# Altium schematic sheet Minion.SchDoc (part 3 of 4)
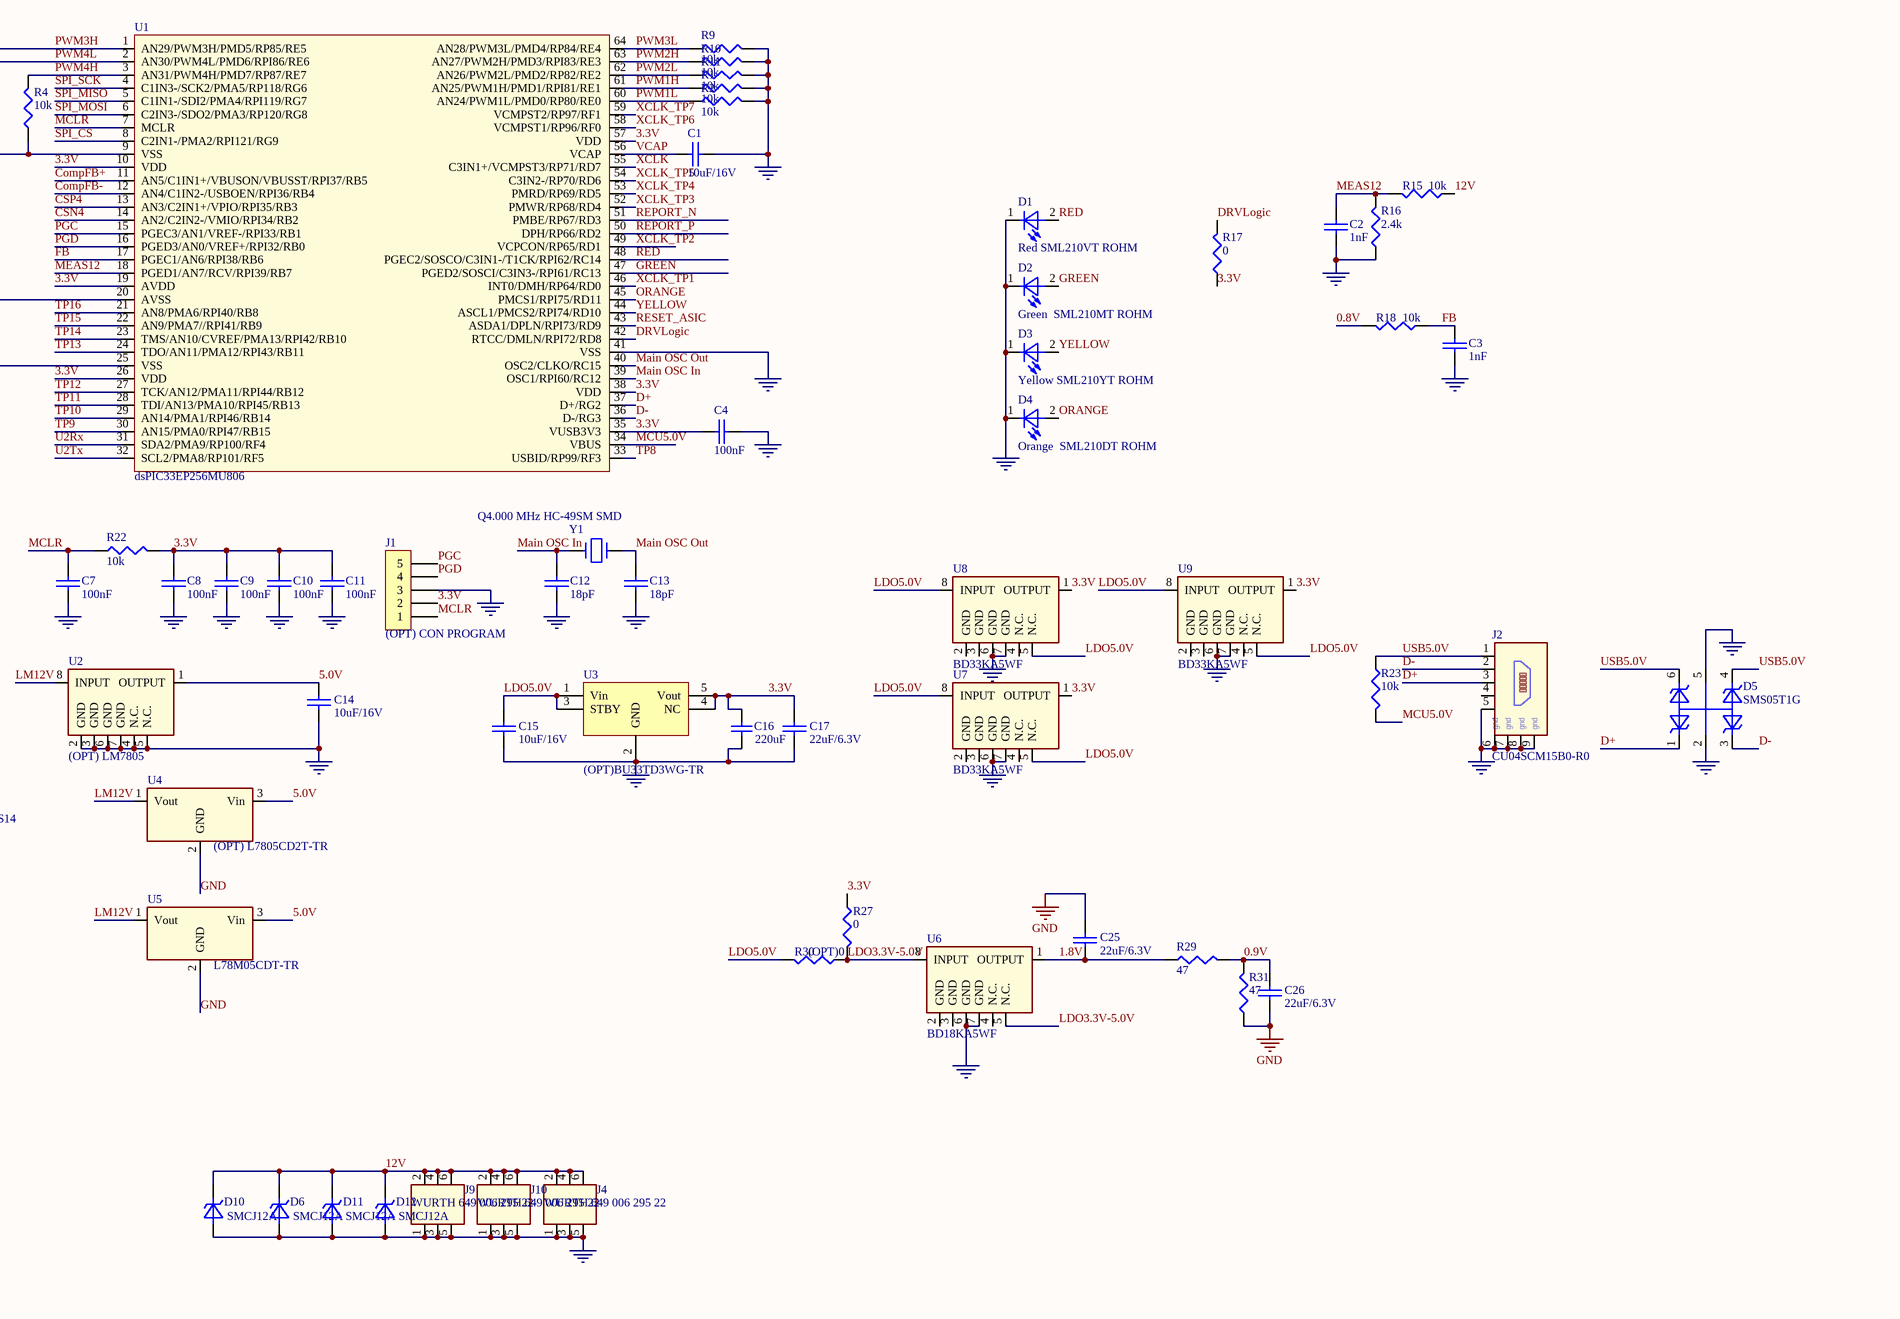
[diagram p7: Minion.SchDoc, bottom right]

## Nets (continued)
GND: C1.2 C1P_1.1 C1P_2.1 C1P_3.1 C1P_4.1 C1P_5.1 C1P_6.1 C1P_7.1 C1P_8.1 C2.2 C2P_1.2 C2P_2.2 C2P_3.2 C2P_4.2 C2P_5.2 C2P_6.2 C2P_7.2 C2P_8.2 C3.2 C4.2 C4P_1.2 C4P_2.2 C4P_3.2 C4P_4.2 C4P_5.2 C4P_6.2 C4P_7.2 C4P_8.2 C5P_1.2 C5P_2.2 C5P_3.2 C5P_4.2 C5P_5.2 C5P_6.2 C5P_7.2 C5P_8.2 C6P_1.2 C6P_2.2 C6P_3.2 C6P_4.2 C6P_5.2 C6P_6.2 C6P_7.2 C6P_8.2 C7.2 C7P_1.2 C7P_2.2 C7P_3.2 C7P_4.2 C7P_5.2 C7P_6.2 C7P_7.2 C7P_8.2 C8.2 C8P_1.2 C8P_2.2 C8P_3.2 C8P_4.2 C8P_5.2 C8P_6.2 C8P_7.2 C8P_8.2 C9.2 C9P_1.2 C9P_2.2 C9P_3.2 C9P_4.2 C9P_5.2 C9P_6.2 C9P_7.2 C9P_8.2 C10.2 C10P_1.2 C10P_2.2 C10P_3.2 C10P_4.2 C10P_5.2 C10P_6.2 C10P_7.2 C10P_8.2 C11.2 C11P_1.2 C11P_2.2 C11P_3.2 C11P_4.2 C11P_5.2 C11P_6.2 C11P_7.2 C11P_8.2 C12.2 C12P_1.2 C12P_2.2 C12P_3.2 C12P_4.2 C12P_5.2 C12P_6.2 C12P_7.2 C12P_8.2 C13.2 C14.2 C15.2 C16.2 C17.2 C25.1 C26.2 CF_1.2 CF_2.2 CF_3.2 CF_4.2 CF_5.2 CF_6.2 CF_7.2 CF_8.2 CF_9.2 CF_10.2 CF_11.2 CF_12.2 CF_13.2 CF_14.2 CF_15.2 CF_16.2 CF_17.2 CF_18.2 CF_19.2 CF_20.2 CF_21.2 CF_22.2 CF_23.2 CF_24.2 CF_25.2 CF_26.2 CF_27.2 CF_28.2 CF_29.2 CF_30.2 CF_31.2 CF_32.2 CF_33.2 CF_34.2 CF_35.2 CF_36.2 CF_37.2 CF_38.2 CF_39.2 CF_40.2 CF_41.2 CF_42.2 CF_43.2 CF_44.2 CF_45.2 CF_46.2 CF_47.2 CF_48.2 CF_49.2 CF_50.2 CF_51.2 CF_52.2 CF_53.2 CF_54.2 CF_55.2 CF_56.2 CF_57.2 CF_58.2 CF_59.2 CF_60.2 CF_61.2 CF_62.2 CF_63.2 CF_64.2 CF_65.2 CF_66.2 CF_67.2 CF_68.2 CF_69.2 CF_70.2 CF_71.2 CF_72.2 CF_73.2 CF_74.2 CF_75.2 CF_76.2 CF_77.2 CF_78.2 CF_79.2 CF_80.2 CF_81.2 CF_82.2 CF_83.2 CF_84.2 CF_85.2 CF_86.2 CF_87.2 CF_88.2 CF_89.2 CF_90.2 CF_91.2 CF_92.2 CF_93.2 CF_94.2 CF_95.2 CF_96.2 CF_97.2 CF_98.2 CF_99.2 CF_100.2 CF_101.2 CF_102.2 CF_103.2 CF_104.2 CF_105.2 CF_106.2 CF_107.2 CF_108.2 CF_109.2 CF_110.2 CF_111.2 CF_112.2 CM_1.2 CM_2.2 CM_3.2 CM_4.2 CM_5.2 CM_6.2 CM_7.2 CM_8.2 CM_9.2 CM_10.2 CM_11.2 CM_12.2 CM_13.2 CM_14.2 CM_15.2 CM_16.2 CM_17.2 CM_18.2 CM_19.2 CM_20.2 CM_21.2 CM_22.2 CM_23.2 CM_24.2 CM_25.2 CM_26.2 CM_27.2 CM_28.2 CM_29.2 CM_30.2 CM_31.2 CM_32.2 CM_33.2 CM_34.2 CM_35.2 CM_36.2 CM_37.2 CM_38.2 CM_39.2 CM_40.2 CM_41.2 CM_42.2 CM_43.2 CM_44.2 CM_45.2 CM_46.2 CM_47.2 CM_48.2 CM_49.2 CM_50.2 CM_51.2 CM_52.2 CM_53.2 CM_54.2 CM_55.2 CM_56.2 CM_57.2 CM_58.2 CM_59.2 CM_60.2 CM_61.2 CM_62.2 CM_63.2 CM_64.2 CM_65.2 CM_66.2 CM_67.2 CM_68.2 CM_69.2 CM_70.2 CM_71.2 CM_72.2 CM_73.2 CM_74.2 CM_75.2 CM_76.2 CM_77.2 CM_78.2 CM_79.2 CM_80.2 CM_81.2 CM_82.2 CM_83.2 CM_84.2 CM_85.2 CM_86.2 CM_87.2 CM_88.2 CM_89.2 CM_90.2 CM_91.2 CM_92.2 CM_93.2 CM_94.2 CM_95.2 CM_96.2 CM_97.2 CM_98.2 CM_99.2 CM_100.2 CM_101.2 CM_102.2 CM_103.2 CM_104.2 CM_105.2 CM_106.2 CM_107.2 CM_108.2 CM_109.2 CM_110.2 CM_111.2 CM_112.2 CO1_1.2 CO1_2.2 CO1_3.2 CO1_4.2 CO2_1.2 CO2_2.2 CO2_3.2 CO2_4.2 CO3_1.2 CO3_2.2 CO3_3.2 CO3_4.2 CO4_1.2 CO4_2.2 CO4_3.2 CO4_4.2 CO5_1.2 CO5_2.2 CO5_3.2 CO5_4.2 CO6_1.2 CO6_2.2 CO6_3.2 CO6_4.2 CO7_1.2 CO7_2.2 CO7_3.2 CO7_4.2 CO8_1.2 CO8_2.2 CO8_3.2 CO8_4.2 D1.1(C) D2.1(C) D3.1(C) D4.1(C) D5.2(AAAA) D5.5(C4) D6.2(A) D10.2(A) D11.2(A) D12.2(A) DI1_1.1(C) DI1_2.1(C) DI1_3.1(C) DI1_4.1(C) DI2_1.1(C) DI2_2.1(C) DI2_3.1(C) DI2_4.1(C) DI3_1.1(C) DI3_2.1(C) DI3_3.1(C) DI3_4.1(C) DI4_1.1(C) DI4_2.1(C) DI4_3.1(C) DI4_4.1(C) DI5_1.1(C) DI5_2.1(C) DI5_3.1(C) DI5_4.1(C) DI6_1.1(C) DI6_2.1(C) DI6_3.1(C) DI6_4.1(C) DI7_1.1(C) DI7_2.1(C) DI7_3.1(C) DI7_4.1(C) DI8_1.1(C) DI8_2.1(C) DI8_3.1(C) DI8_4.1(C) DI9_1.1(C) DI9_2.1(C) DI9_3.1(C) DI9_4.1(C) J1.3 J2.5 J2.6 J2.7 J2.8 J2.9 J4.1 J4.3 J4.5 J5.1(GND) J6.1(GND) J7.1(GND) J8.1(GND) J9.1 J9.3 J9.5 J10.1 J10.3 J10.5 J12.4 J13.4 J14.4 J15.4 Q2P_1.1(S) Q2P_1.2(S) Q2P_1.3(S) Q2P_2.1(S) Q2P_2.2(S) Q2P_2.3(S) Q2P_3.1(S) Q2P_3.2(S) Q2P_3.3(S) Q2P_4.1(S) Q2P_4.2(S) Q2P_4.3(S) Q2P_5.1(S) Q2P_5.2(S) Q2P_5.3(S) Q2P_6.1(S) Q2P_6.2(S) Q2P_6.3(S) Q2P_7.1(S) Q2P_7.2(S) Q2P_7.3(S) Q2P_8.1(S) Q2P_8.2(S) Q2P_8.3(S) Q3P_1.1(S) Q3P_1.2(S) Q3P_1.3(S) Q3P_2.1(S) Q3P_2.2(S) Q3P_2.3(S) Q3P_3.1(S) Q3P_3.2(S) Q3P_3.3(S) Q3P_4.1(S) Q3P_4.2(S) Q3P_4.3(S) Q3P_5.1(S) Q3P_5.2(S) Q3P_5.3(S) Q3P_6.1(S) Q3P_6.2(S) Q3P_6.3(S) Q3P_7.1(S) Q3P_7.2(S) Q3P_7.3(S) Q3P_8.1(S) Q3P_8.2(S) Q3P_8.3(S) QO1_1.2(E) QO1_2.2(E) QO1_3.2(E) QO1_4.2(E) R1.2 R2.2 R3.1 R4.1 R9.2 R10.2 R11.2 R12.1 R16.1 R31.1 RI1_1.2 RI1_2.2 RI1_3.2 RI1_4.2 RI2_1.2 RI2_2.2 RI2_3.2 RI2_4.2 U1.9(VSS) U1.20(AVSS) U1.25(VSS) U1.41(VSS) U1_1.A1(CORE_VSS) U1_1.A3(CORE_VSS) U1_1.A5(CORE_VSS) U1_1.A7(CORE_VSS) U1_1.A9(CORE_VSS) U1_1.A11(CORE_VSS) U1_1.A13(CORE_VSS) U1_1.A15(CORE_VSS) U1_1.A17(CORE_VSS) U1_1.A19(CORE_VSS) U1_1.A21(CORE_VSS) U1_1.A23(CORE_VSS) U1_1.A25(CORE_VSS) U1_1.A27(CORE_VSS) U1_1.A29(CORE_VSS) U1_1.AA1(CORE_VSS) U1_1.AA3(CORE_VSS) U1_1.AA5(CORE_VSS) U1_1.AA7(CORE_VSS) U1_1.AA9(CORE_VSS) U1_1.AA11(CORE_VSS) U1_1.AA13(CORE_VSS) U1_1.AA15(CORE_VSS) U1_1.AA17(CORE_VSS) U1_1.AA19(CORE_VSS) U1_1.AA21(CORE_VSS) U1_1.AA23(CORE_VSS) U1_1.AA25(CORE_VSS) U1_1.AA27(CORE_VSS) U1_1.AA29(CORE_VSS) U1_1.AB2(CORE_VSS) U1_1.AB4(CORE_VSS) U1_1.AB6(CORE_VSS) U1_1.AB8(CORE_VSS) U1_1.AB10(CORE_VSS) U1_1.AB12(CORE_VSS) U1_1.AB14(CORE_VSS) U1_1.AB16(CORE_VSS) U1_1.AB18(CORE_VSS) U1_1.AB20(CORE_VSS) U1_1.AB22(CORE_VSS) U1_1.AB24(CORE_VSS) U1_1.AB26(CORE_VSS) U1_1.AB28(CORE_VSS) U1_1.AB30(CORE_VSS) U1_1.AC1(CORE_VSS) U1_1.AC3(CORE_VSS) U1_1.AC5(CORE_VSS) U1_1.AC7(CORE_VSS) U1_1.AC9(CORE_VSS) U1_1.AC11(CORE_VSS) U1_1.AC13(CORE_VSS) U1_1.AC15(CORE_VSS) U1_1.AC17(CORE_VSS) U1_1.AC19(CORE_VSS) U1_1.AC21(CORE_VSS) U1_1.AC23(CORE_VSS) U1_1.AC25(CORE_VSS) U1_1.AC27(CORE_VSS) U1_1.AC29(CORE_VSS) U1_1.AD2(CORE_VSS) U1_1.AD4(CORE_VSS) U1_1.AD6(CORE_VSS) U1_1.AD8(CORE_VSS) U1_1.AD10(CORE_VSS) U1_1.AD12(CORE_VSS) U1_1.AD14(CORE_VSS) U1_1.AD16(CORE_VSS) U1_1.AD18(CORE_VSS) U1_1.AD20(CORE_VSS) U1_1.AD22(CORE_VSS) U1_1.AD24(CORE_VSS) U1_1.AD26(CORE_VSS) U1_1.AD28(CORE_VSS) U1_1.AD30(CORE_VSS) U1_1.AE1(CORE_VSS) U1_1.AE3(CORE_VSS) U1_1.AE5(CORE_VSS) U1_1.AE7(CORE_VSS) U1_1.AE9(CORE_VSS) U1_1.AE11(CORE_VSS) U1_1.AE13(CORE_VSS) U1_1.AE15(CORE_VSS) U1_1.AE17(CORE_VSS) U1_1.AE19(CORE_VSS) U1_1.AE21(CORE_VSS) U1_1.AE23(CORE_VSS) U1_1.AE25(CORE_VSS) U1_1.AE27(CORE_VSS) U1_1.AE29(CORE_VSS) U1_1.AF2(CORE_VSS) U1_1.AF4(CORE_VSS) U1_1.AF6(CORE_VSS) U1_1.AF8(CORE_VSS) U1_1.AF10(CORE_VSS) U1_1.AF12(CORE_VSS) U1_1.AF14(CORE_VSS) U1_1.AF16(CORE_VSS) U1_1.AF18(CORE_VSS) U1_1.AF20(CORE_VSS) U1_1.AF22(CORE_VSS) U1_1.AF24(CORE_VSS) U1_1.AF26(CORE_VSS) U1_1.AF28(CORE_VSS) U1_1.AF30(CORE_VSS) U1_1.AG1(CORE_VSS) U1_1.AG3(CORE_VSS) U1_1.AG5(CORE_VSS) U1_1.AG7(CORE_VSS) U1_1.AG9(CORE_VSS) U1_1.AG11(CORE_VSS) U1_1.AG13(CORE_VSS) U1_1.AG15(CORE_VSS) U1_1.AG17(CORE_VSS) U1_1.AG19(CORE_VSS) U1_1.AG21(CORE_VSS) U1_1.AG23(CORE_VSS) U1_1.AG25(CORE_VSS) U1_1.AG27(CORE_VSS) U1_1.AG29(CORE_VSS) U1_1.AH2(CORE_VSS) U1_1.AH4(CORE_VSS) U1_1.AH6(CORE_VSS) U1_1.AH8(CORE_VSS) U1_1.AH10(CORE_VSS) U1_1.AH12(CORE_VSS) U1_1.AH14(CORE_VSS) U1_1.AH16(CORE_VSS) U1_1.AH18(CORE_VSS) U1_1.AH20(CORE_VSS) U1_1.AH22(CORE_VSS) U1_1.AH24(CORE_VSS) U1_1.AH26(CORE_VSS) U1_1.AH28(CORE_VSS) U1_1.AH30(CORE_VSS) U1_1.AJ1(CORE_VSS) U1_1.AJ3(CORE_VSS) U1_1.AJ4(IO_VSS) U1_1.AJ6(IO_VSS) U1_1.AJ9(CORE_VSS) U1_1.AJ11(IO_VSS) U1_1.AJ17(CORE_VSS) U1_1.AJ20(CHIP_ADDR0) U1_1.AJ21(CHIP_ADDR2) U1_1.AJ22(CHIP_ADDR4) U1_1.AJ26(SPI_MODE) U1_1.AJ27(CORE_VSS) U1_1.AJ29(CORE_VSS) U1_1.AK2(CORE_VSS) U1_1.AK11(TD_AVSS18) U1_1.AK12(POR_AGND18) U1_1.AK14(CORE_VSS) U1_1.AK15(PLL_AVSS) U1_1.AK16(PLL_AVSS2) U1_1.AK17(IO_VSS) U1_1.AK20(CORE_VSS) U1_1.AK21(CHIP_ADDR1) U1_1.AK22(CHIP_ADDR3) U1_1.AK23(IO_VSS) U1_1.AK30(CORE_VSS) U1_1.B2(CORE_VSS) U1_1.B4(CORE_VSS) U1_1.B6(CORE_VSS) U1_1.B8(CORE_VSS) U1_1.B10(CORE_VSS) U1_1.B12(CORE_VSS) U1_1.B14(CORE_VSS) U1_1.B16(CORE_VSS) U1_1.B18(CORE_VSS) U1_1.B20(CORE_VSS) U1_1.B22(CORE_VSS) U1_1.B24(CORE_VSS) U1_1.B26(CORE_VSS) U1_1.B28(CORE_VSS) U1_1.B30(CORE_VSS) U1_1.C1(CORE_VSS) U1_1.C3(CORE_VSS) U1_1.C5(CORE_VSS) U1_1.C7(CORE_VSS) U1_1.C9(CORE_VSS) U1_1.C11(CORE_VSS) U1_1.C13(CORE_VSS) U1_1.C15(CORE_VSS) U1_1.C17(CORE_VSS) U1_1.C19(CORE_VSS) U1_1.C21(CORE_VSS) U1_1.C23(CORE_VSS) U1_1.C25(CORE_VSS) U1_1.C27(CORE_VSS) U1_1.C29(CORE_VSS) U1_1.D2(CORE_VSS) U1_1.D4(CORE_VSS) U1_1.D6(CORE_VSS) U1_1.D8(CORE_VSS) U1_1.D10(CORE_VSS) U1_1.D12(CORE_VSS) U1_1.D14(CORE_VSS) U1_1.D16(CORE_VSS) U1_1.D18(CORE_VSS) U1_1.D20(CORE_VSS) U1_1.D22(CORE_VSS) U1_1.D24(CORE_VSS) U1_1.D26(CORE_VSS) U1_1.D28(CORE_VSS) U1_1.D30(CORE_VSS) U1_1.E1(CORE_VSS) U1_1.E3(CORE_VSS) U1_1.E5(CORE_VSS) U1_1.E7(CORE_VSS) U1_1.E9(CORE_VSS) U1_1.E11(CORE_VSS) U1_1.E13(CORE_VSS) U1_1.E15(CORE_VSS) U1_1.E17(CORE_VSS) U1_1.E19(CORE_VSS) U1_1.E21(CORE_VSS) U1_1.E23(CORE_VSS) U1_1.E25(CORE_VSS) U1_1.E27(CORE_VSS) U1_1.E29(CORE_VSS) U1_1.F2(CORE_VSS) U1_1.F4(CORE_VSS) U1_1.F6(CORE_VSS) U1_1.F8(CORE_VSS) U1_1.F10(CORE_VSS) U1_1.F12(CORE_VSS) U1_1.F14(CORE_VSS) U1_1.F16(CORE_VSS) U1_1.F18(CORE_VSS) U1_1.F20(CORE_VSS) U1_1.F22(CORE_VSS) U1_1.F24(CORE_VSS) U1_1.F26(CORE_VSS) U1_1.F28(CORE_VSS) U1_1.F30(CORE_VSS) U1_1.G1(CORE_VSS) U1_1.G3(CORE_VSS) U1_1.G5(CORE_VSS) U1_1.G7(CORE_VSS) U1_1.G9(CORE_VSS) U1_1.G11(CORE_VSS) U1_1.G13(CORE_VSS) U1_1.G15(CORE_VSS) U1_1.G17(CORE_VSS) U1_1.G19(CORE_VSS) U1_1.G21(CORE_VSS) U1_1.G23(CORE_VSS) U1_1.G25(CORE_VSS) U1_1.G27(CORE_VSS) U1_1.G29(CORE_VSS) U1_1.H2(CORE_VSS) U1_1.H4(CORE_VSS) U1_1.H6(CORE_VSS) U1_1.H8(CORE_VSS) U1_1.H10(CORE_VSS) U1_1.H12(CORE_VSS) U1_1.H14(CORE_VSS) U1_1.H16(CORE_VSS) U1_1.H18(CORE_VSS) U1_1.H20(CORE_VSS) U1_1.H22(CORE_VSS) U1_1.H24(CORE_VSS) U1_1.H26(CORE_VSS) U1_1.H28(CORE_VSS) U1_1.H30(CORE_VSS) U1_1.J1(CORE_VSS) U1_1.J3(CORE_VSS) U1_1.J5(CORE_VSS) U1_1.J7(CORE_VSS) U1_1.J9(CORE_VSS) U1_1.J11(CORE_VSS) U1_1.J13(CORE_VSS) U1_1.J15(CORE_VSS) U1_1.J17(CORE_VSS) U1_1.J19(CORE_VSS) U1_1.J21(CORE_VSS) U1_1.J23(CORE_VSS) U1_1.J25(CORE_VSS) U1_1.J27(CORE_VSS) U1_1.J29(CORE_VSS) U1_1.K2(CORE_VSS) U1_1.K4(CORE_VSS) U1_1.K6(CORE_VSS) U1_1.K8(CORE_VSS) U1_1.K10(CORE_VSS) U1_1.K12(CORE_VSS) U1_1.K14(CORE_VSS) U1_1.K16(CORE_VSS) U1_1.K18(CORE_VSS) U1_1.K20(CORE_VSS) U1_1.K22(CORE_VSS) U1_1.K24(CORE_VSS) U1_1.K26(CORE_VSS) U1_1.K28(CORE_VSS) U1_1.K30(CORE_VSS) U1_1.L1(CORE_VSS) U1_1.L3(CORE_VSS) U1_1.L5(CORE_VSS) U1_1.L7(CORE_VSS) U1_1.L9(CORE_VSS) U1_1.L11(CORE_VSS) U1_1.L13(CORE_VSS) U1_1.L15(CORE_VSS) U1_1.L17(CORE_VSS) U1_1.L19(CORE_VSS) U1_1.L21(CORE_VSS) U1_1.L23(CORE_VSS) U1_1.L25(CORE_VSS) U1_1.L27(CORE_VSS) U1_1.L29(CORE_VSS) U1_1.M2(CORE_VSS) U1_1.M4(CORE_VSS) U1_1.M6(CORE_VSS) U1_1.M8(CORE_VSS) U1_1.M10(CORE_VSS) U1_1.M12(CORE_VSS) U1_1.M14(CORE_VSS) U1_1.M16(CORE_VSS) U1_1.M18(CORE_VSS) U1_1.M20(CORE_VSS) U1_1.M22(CORE_VSS) U1_1.M24(CORE_VSS) U1_1.M26(CORE_VSS) U1_1.M28(CORE_VSS) U1_1.M30(CORE_VSS) U1_1.N1(CORE_VSS) U1_1.N3(CORE_VSS) U1_1.N5(CORE_VSS) U1_1.N7(CORE_VSS) U1_1.N9(CORE_VSS) U1_1.N11(CORE_VSS) U1_1.N13(CORE_VSS) U1_1.N15(CORE_VSS) U1_1.N17(CORE_VSS) U1_1.N19(CORE_VSS) U1_1.N21(CORE_VSS) U1_1.N23(CORE_VSS) U1_1.N25(CORE_VSS) U1_1.N27(CORE_VSS) U1_1.N29(CORE_VSS) U1_1.P2(CORE_VSS) U1_1.P4(CORE_VSS) U1_1.P6(CORE_VSS) U1_1.P8(CORE_VSS) U1_1.P10(CORE_VSS) U1_1.P12(CORE_VSS) U1_1.P14(CORE_VSS) U1_1.P16(CORE_VSS) U1_1.P18(CORE_VSS) U1_1.P20(CORE_VSS) U1_1.P22(CORE_VSS) U1_1.P24(CORE_VSS) U1_1.P26(CORE_VSS) U1_1.P28(CORE_VSS) U1_1.P30(CORE_VSS) U1_1.R1(CORE_VSS) U1_1.R3(CORE_VSS) U1_1.R5(CORE_VSS) U1_1.R7(CORE_VSS) U1_1.R9(CORE_VSS) U1_1.R11(CORE_VSS) U1_1.R13(CORE_VSS) U1_1.R15(CORE_VSS) U1_1.R17(CORE_VSS) U1_1.R19(CORE_VSS) U1_1.R21(CORE_VSS) U1_1.R23(CORE_VSS) U1_1.R25(CORE_VSS) U1_1.R27(CORE_VSS) U1_1.R29(CORE_VSS) U1_1.T2(CORE_VSS) U1_1.T4(CORE_VSS) U1_1.T6(CORE_VSS) U1_1.T8(CORE_VSS) U1_1.T10(CORE_VSS) U1_1.T12(CORE_VSS) U1_1.T14(CORE_VSS) U1_1.T16(CORE_VSS) U1_1.T18(CORE_VSS) U1_1.T20(CORE_VSS) U1_1.T22(CORE_VSS) U1_1.T24(CORE_VSS) U1_1.T26(CORE_VSS) U1_1.T28(CORE_VSS) U1_1.T30(CORE_VSS) U1_1.U1(CORE_VSS) U1_1.U3(CORE_VSS) U1_1.U5(CORE_VSS) U1_1.U7(CORE_VSS) U1_1.U9(CORE_VSS) U1_1.U11(CORE_VSS) U1_1.U13(CORE_VSS) U1_1.U15(CORE_VSS) U1_1.U17(CORE_VSS) U1_1.U19(CORE_VSS) U1_1.U21(CORE_VSS) U1_1.U23(CORE_VSS) U1_1.U25(CORE_VSS) U1_1.U27(CORE_VSS) U1_1.U29(CORE_VSS) U1_1.V2(CORE_VSS) U1_1.V4(CORE_VSS) U1_1.V6(CORE_VSS) U1_1.V8(CORE_VSS) U1_1.V10(CORE_VSS) U1_1.V12(CORE_VSS) U1_1.V14(CORE_VSS) U1_1.V16(CORE_VSS) U1_1.V18(CORE_VSS) U1_1.V20(CORE_VSS) U1_1.V22(CORE_VSS) U1_1.V24(CORE_VSS) U1_1.V26(CORE_VSS) U1_1.V28(CORE_VSS) U1_1.V30(CORE_VSS) U1_1.W1(CORE_VSS) U1_1.W3(CORE_VSS) U1_1.W5(CORE_VSS) U1_1.W7(CORE_VSS) U1_1.W9(CORE_VSS) U1_1.W11(CORE_VSS) U1_1.W13(CORE_VSS) U1_1.W15(CORE_VSS) U1_1.W17(CORE_VSS) U1_1.W19(CORE_VSS) U1_1.W21(CORE_VSS) U1_1.W23(CORE_VSS) U1_1.W25(CORE_VSS) U1_1.W27(CORE_VSS) U1_1.W29(CORE_VSS) U1_1.Y2(CORE_VSS) U1_1.Y4(CORE_VSS) U1_1.Y6(CORE_VSS) U1_1.Y8(CORE_VSS) U1_1.Y10(CORE_VSS) U1_1.Y12(CORE_VSS) U1_1.Y14(CORE_VSS) U1_1.Y16(CORE_VSS) U1_1.Y18(CORE_VSS) U1_1.Y20(CORE_VSS) U1_1.Y22(CORE_VSS) U1_1.Y24(CORE_VSS) U1_1.Y26(CORE_VSS) U1_1.Y28(CORE_VSS) U1_1.Y30(CORE_VSS) U1_2.A1(CORE_VSS) U1_2.A3(CORE_VSS) U1_2.A5(CORE_VSS) U1_2.A7(CORE_VSS) U1_2.A9(CORE_VSS) U1_2.A11(CORE_VSS) U1_2.A13(CORE_VSS) U1_2.A15(CORE_VSS) U1_2.A17(CORE_VSS) U1_2.A19(CORE_VSS) U1_2.A21(CORE_VSS) U1_2.A23(CORE_VSS) U1_2.A25(CORE_VSS) U1_2.A27(CORE_VSS) U1_2.A29(CORE_VSS) U1_2.AA1(CORE_VSS) U1_2.AA3(CORE_VSS) U1_2.AA5(CORE_VSS) U1_2.AA7(CORE_VSS) U1_2.AA9(CORE_VSS) U1_2.AA11(CORE_VSS) U1_2.AA13(CORE_VSS) U1_2.AA15(CORE_VSS) U1_2.AA17(CORE_VSS) U1_2.AA19(CORE_VSS) U1_2.AA21(CORE_VSS) U1_2.AA23(CORE_VSS) U1_2.AA25(CORE_VSS) U1_2.AA27(CORE_VSS) U1_2.AA29(CORE_VSS) U1_2.AB2(CORE_VSS) U1_2.AB4(CORE_VSS) U1_2.AB6(CORE_VSS) U1_2.AB8(CORE_VSS) U1_2.AB10(CORE_VSS) U1_2.AB12(CORE_VSS) U1_2.AB14(CORE_VSS) U1_2.AB16(CORE_VSS) U1_2.AB18(CORE_VSS) U1_2.AB20(CORE_VSS) U1_2.AB22(CORE_VSS) U1_2.AB24(CORE_VSS) U1_2.AB26(CORE_VSS) U1_2.AB28(CORE_VSS) U1_2.AB30(CORE_VSS) U1_2.AC1(CORE_VSS) U1_2.AC3(CORE_VSS) U1_2.AC5(CORE_VSS) U1_2.AC7(CORE_VSS) U1_2.AC9(CORE_VSS) U1_2.AC11(CORE_VSS) U1_2.AC13(CORE_VSS) U1_2.AC15(CORE_VSS) U1_2.AC17(CORE_VSS) U1_2.AC19(CORE_VSS) U1_2.AC21(CORE_VSS) U1_2.AC23(CORE_VSS) U1_2.AC25(CORE_VSS) U1_2.AC27(CORE_VSS) U1_2.AC29(CORE_VSS) U1_2.AD2(CORE_VSS) U1_2.AD4(CORE_VSS) U1_2.AD6(CORE_VSS) U1_2.AD8(CORE_VSS) U1_2.AD10(CORE_VSS) U1_2.AD12(CORE_VSS) U1_2.AD14(CORE_VSS) U1_2.AD16(CORE_VSS) U1_2.AD18(CORE_VSS) U1_2.AD20(CORE_VSS) U1_2.AD22(CORE_VSS) U1_2.AD24(CORE_VSS) U1_2.AD26(CORE_VSS) U1_2.AD28(CORE_VSS) U1_2.AD30(CORE_VSS) U1_2.AE1(CORE_VSS) U1_2.AE3(CORE_VSS) U1_2.AE5(CORE_VSS) U1_2.AE7(CORE_VSS) U1_2.AE9(CORE_VSS) U1_2.AE11(CORE_VSS) U1_2.AE13(CORE_VSS) U1_2.AE15(CORE_VSS) U1_2.AE17(CORE_VSS) U1_2.AE19(CORE_VSS) U1_2.AE21(CORE_VSS) U1_2.AE23(CORE_VSS) U1_2.AE25(CORE_VSS) U1_2.AE27(CORE_VSS) U1_2.AE29(CORE_VSS) U1_2.AF2(CORE_VSS) U1_2.AF4(CORE_VSS) U1_2.AF6(CORE_VSS) U1_2.AF8(CORE_VSS) U1_2.AF10(CORE_VSS) U1_2.AF12(CORE_VSS) U1_2.AF14(CORE_VSS) U1_2.AF16(CORE_VSS) U1_2.AF18(CORE_VSS) U1_2.AF20(CORE_VSS) U1_2.AF22(CORE_VSS) U1_2.AF24(CORE_VSS) U1_2.AF26(CORE_VSS) U1_2.AF28(CORE_VSS) U1_2.AF30(CORE_VSS) U1_2.AG1(CORE_VSS) U1_2.AG3(CORE_VSS) U1_2.AG5(CORE_VSS) U1_2.AG7(CORE_VSS) U1_2.AG9(CORE_VSS) U1_2.AG11(CORE_VSS) U1_2.AG13(CORE_VSS) U1_2.AG15(CORE_VSS) U1_2.AG17(CORE_VSS) U1_2.AG19(CORE_VSS) U1_2.AG21(CORE_VSS) U1_2.AG23(CORE_VSS) U1_2.AG25(CORE_VSS) U1_2.AG27(CORE_VSS) U1_2.AG29(CORE_VSS) U1_2.AH2(CORE_VSS) U1_2.AH4(CORE_VSS) U1_2.AH6(CORE_VSS) U1_2.AH8(CORE_VSS) U1_2.AH10(CORE_VSS) U1_2.AH12(CORE_VSS) U1_2.AH14(CORE_VSS) U1_2.AH16(CORE_VSS) U1_2.AH18(CORE_VSS) U1_2.AH20(CORE_VSS) U1_2.AH22(CORE_VSS) U1_2.AH24(CORE_VSS) U1_2.AH26(CORE_VSS) U1_2.AH28(CORE_VSS) U1_2.AH30(CORE_VSS) U1_2.AJ1(CORE_VSS) U1_2.AJ3(CORE_VSS) U1_2.AJ4(IO_VSS) U1_2.AJ6(IO_VSS) U1_2.AJ9(CORE_VSS) U1_2.AJ11(IO_VSS) U1_2.AJ17(CORE_VSS) U1_2.AJ21(CHIP_ADDR2) U1_2.AJ22(CHIP_ADDR4) U1_2.AJ26(SPI_MODE) U1_2.AJ27(CORE_VSS) U1_2.AJ29(CORE_VSS) U1_2.AK2(CORE_VSS) U1_2.AK11(TD_AVSS18) U1_2.AK12(POR_AGND18) U1_2.AK14(CORE_VSS) U1_2.AK15(PLL_AVSS) U1_2.AK16(PLL_AVSS2) U1_2.AK17(IO_VSS) U1_2.AK20(CORE_VSS) U1_2.AK21(CHIP_ADDR1) U1_2.AK22(CHIP_ADDR3) U1_2.AK23(IO_VSS) U1_2.AK30(CORE_VSS) U1_2.B2(CORE_VSS) U1_2.B4(CORE_VSS) U1_2.B6(CORE_VSS) U1_2.B8(CORE_VSS) U1_2.B10(CORE_VSS) U1_2.B12(CORE_VSS) U1_2.B14(CORE_VSS) U1_2.B16(CORE_VSS) U1_2.B18(CORE_VSS) U1_2.B20(CORE_VSS) U1_2.B22(CORE_VSS) U1_2.B24(CORE_VSS) U1_2.B26(CORE_VSS) U1_2.B28(CORE_VSS) U1_2.B30(CORE_VSS) U1_2.C1(CORE_VSS) U1_2.C3(CORE_VSS) U1_2.C5(CORE_VSS) U1_2.C7(CORE_VSS) U1_2.C9(CORE_VSS) U1_2.C11(CORE_VSS) U1_2.C13(CORE_VSS) U1_2.C15(CORE_VSS) U1_2.C17(CORE_VSS) U1_2.C19(CORE_VSS) U1_2.C21(CORE_VSS) U1_2.C23(CORE_VSS) U1_2.C25(CORE_VSS) U1_2.C27(CORE_VSS) U1_2.C29(CORE_VSS) U1_2.D2(CORE_VSS) U1_2.D4(CORE_VSS) U1_2.D6(CORE_VSS) U1_2.D8(CORE_VSS) U1_2.D10(CORE_VSS) U1_2.D12(CORE_VSS) U1_2.D14(CORE_VSS) U1_2.D16(CORE_VSS) U1_2.D18(CORE_VSS) U1_2.D20(CORE_VSS) U1_2.D22(CORE_VSS) U1_2.D24(CORE_VSS) U1_2.D26(CORE_VSS) U1_2.D28(CORE_VSS) U1_2.D30(CORE_VSS) U1_2.E1(CORE_VSS) U1_2.E3(CORE_VSS) U1_2.E5(CORE_VSS) U1_2.E7(CORE_VSS) U1_2.E9(CORE_VSS) U1_2.E11(CORE_VSS) U1_2.E13(CORE_VSS) U1_2.E15(CORE_VSS) U1_2.E17(CORE_VSS) U1_2.E19(CORE_VSS) U1_2.E21(CORE_VSS) U1_2.E23(CORE_VSS) U1_2.E25(CORE_VSS) U1_2.E27(CORE_VSS) U1_2.E29(CORE_VSS) U1_2.F2(CORE_VSS) U1_2.F4(CORE_VSS) U1_2.F6(CORE_VSS) U1_2.F8(CORE_VSS) U1_2.F10(CORE_VSS) U1_2.F12(CORE_VSS) U1_2.F14(CORE_VSS) U1_2.F16(CORE_VSS) U1_2.F18(CORE_VSS) U1_2.F20(CORE_VSS) U1_2.F22(CORE_VSS) U1_2.F24(CORE_VSS) U1_2.F26(CORE_VSS) U1_2.F28(CORE_VSS) U1_2.F30(CORE_VSS) U1_2.G1(CORE_VSS) U1_2.G3(CORE_VSS) U1_2.G5(CORE_VSS) U1_2.G7(CORE_VSS) U1_2.G9(CORE_VSS) U1_2.G11(CORE_VSS) U1_2.G13(CORE_VSS) U1_2.G15(CORE_VSS) U1_2.G17(CORE_VSS) U1_2.G19(CORE_VSS) U1_2.G21(CORE_VSS) U1_2.G23(CORE_VSS) U1_2.G25(CORE_VSS) U1_2.G27(CORE_VSS) U1_2.G29(CORE_VSS) U1_2.H2(CORE_VSS) U1_2.H4(CORE_VSS) U1_2.H6(CORE_VSS) U1_2.H8(CORE_VSS) U1_2.H10(CORE_VSS) U1_2.H12(CORE_VSS) U1_2.H14(CORE_VSS) U1_2.H16(CORE_VSS) U1_2.H18(CORE_VSS) U1_2.H20(CORE_VSS) U1_2.H22(CORE_VSS) U1_2.H24(CORE_VSS) U1_2.H26(CORE_VSS) U1_2.H28(CORE_VSS) U1_2.H30(CORE_VSS) U1_2.J1(CORE_VSS) U1_2.J3(CORE_VSS) U1_2.J5(CORE_VSS) U1_2.J7(CORE_VSS) U1_2.J9(CORE_VSS) U1_2.J11(CORE_VSS) U1_2.J13(CORE_VSS) U1_2.J15(CORE_VSS) U1_2.J17(CORE_VSS) U1_2.J19(CORE_VSS) U1_2.J21(CORE_VSS) U1_2.J23(CORE_VSS) U1_2.J25(CORE_VSS) U1_2.J27(CORE_VSS) U1_2.J29(CORE_VSS) U1_2.K2(CORE_VSS) U1_2.K4(CORE_VSS) U1_2.K6(CORE_VSS) U1_2.K8(CORE_VSS) U1_2.K10(CORE_VSS) U1_2.K12(CORE_VSS) U1_2.K14(CORE_VSS) U1_2.K16(CORE_VSS) U1_2.K18(CORE_VSS) U1_2.K20(CORE_VSS) U1_2.K22(CORE_VSS) U1_2.K24(CORE_VSS) U1_2.K26(CORE_VSS) U1_2.K28(CORE_VSS) U1_2.K30(CORE_VSS) U1_2.L1(CORE_VSS) U1_2.L3(CORE_VSS) U1_2.L5(CORE_VSS) U1_2.L7(CORE_VSS) U1_2.L9(CORE_VSS) U1_2.L11(CORE_VSS) U1_2.L13(CORE_VSS) U1_2.L15(CORE_VSS) U1_2.L17(CORE_VSS) U1_2.L19(CORE_VSS) U1_2.L21(CORE_VSS) U1_2.L23(CORE_VSS) U1_2.L25(CORE_VSS) U1_2.L27(CORE_VSS) U1_2.L29(CORE_VSS) U1_2.M2(CORE_VSS) U1_2.M4(CORE_VSS) U1_2.M6(CORE_VSS) U1_2.M8(CORE_VSS) U1_2.M10(CORE_VSS) U1_2.M12(CORE_VSS) U1_2.M14(CORE_VSS) U1_2.M16(CORE_VSS) U1_2.M18(CORE_VSS) U1_2.M20(CORE_VSS) U1_2.M22(CORE_VSS) U1_2.M24(CORE_VSS) U1_2.M26(CORE_VSS) U1_2.M28(CORE_VSS) U1_2.M30(CORE_VSS) U1_2.N1(CORE_VSS) U1_2.N3(CORE_VSS) U1_2.N5(CORE_VSS) U1_2.N7(CORE_VSS) U1_2.N9(CORE_VSS) U1_2.N11(CORE_VSS) U1_2.N13(CORE_VSS) U1_2.N15(CORE_VSS) U1_2.N17(CORE_VSS) U1_2.N19(CORE_VSS) U1_2.N21(CORE_VSS) U1_2.N23(CORE_VSS) U1_2.N25(CORE_VSS) U1_2.N27(CORE_VSS) U1_2.N29(CORE_VSS) U1_2.P2(CORE_VSS) U1_2.P4(CORE_VSS) U1_2.P6(CORE_VSS) U1_2.P8(CORE_VSS) U1_2.P10(CORE_VSS) U1_2.P12(CORE_VSS) U1_2.P14(CORE_VSS) U1_2.P16(CORE_VSS) U1_2.P18(CORE_VSS) U1_2.P20(CORE_VSS) U1_2.P22(CORE_VSS) U1_2.P24(CORE_VSS) U1_2.P26(CORE_VSS) U1_2.P28(CORE_VSS) U1_2.P30(CORE_VSS) U1_2.R1(CORE_VSS) U1_2.R3(CORE_VSS) U1_2.R5(CORE_VSS) U1_2.R7(CORE_VSS) U1_2.R9(CORE_VSS) U1_2.R11(CORE_VSS) U1_2.R13(CORE_VSS) U1_2.R15(CORE_VSS) U1_2.R17(CORE_VSS) U1_2.R19(CORE_VSS) U1_2.R21(CORE_VSS) U1_2.R23(CORE_VSS) U1_2.R25(CORE_VSS) U1_2.R27(CORE_VSS) U1_2.R29(CORE_VSS) U1_2.T2(CORE_VSS) U1_2.T4(CORE_VSS) U1_2.T6(CORE_VSS) U1_2.T8(CORE_VSS) U1_2.T10(CORE_VSS) U1_2.T12(CORE_VSS) U1_2.T14(CORE_VSS) U1_2.T16(CORE_VSS) U1_2.T18(CORE_VSS) U1_2.T20(CORE_VSS) U1_2.T22(CORE_VSS) U1_2.T24(CORE_VSS) U1_2.T26(CORE_VSS) 